# EAGLE schematic Resistor_Resistor (EAGLE 8.3.0), part 20 of 43
## Parts (continued)
R27278  10K  RESISTOR_0201  [0201]
R27279  10K  RESISTOR_0201  [0201]
R27280  10K  RESISTOR_0201  [0201]
R27281  10K  RESISTOR_0201  [0201]
R27282  10K  RESISTOR_0201  [0201]
R27283  10K  RESISTOR_0201  [0201]
R27284  10K  RESISTOR_0201  [0201]
R27285  10K  RESISTOR_0201  [0201]
R27286  10K  RESISTOR_0201  [0201]
R27287  10K  RESISTOR_0201  [0201]
R27288  10K  RESISTOR_0201  [0201]
R27289  10K  RESISTOR_0201  [0201]
R27290  10K  RESISTOR_0201  [0201]
R27291  10K  RESISTOR_0201  [0201]
R27292  10K  RESISTOR_0201  [0201]
R27293  10K  RESISTOR_0201  [0201]
R27294  10K  RESISTOR_0201  [0201]
R27295  10K  RESISTOR_0201  [0201]
R27296  10K  RESISTOR_0201  [0201]
R27297  10K  RESISTOR_0201  [0201]
R27298  10K  RESISTOR_0201  [0201]
R27299  10K  RESISTOR_0201  [0201]
R27300  10K  RESISTOR_0201  [0201]
R27301  10K  RESISTOR_0201  [0201]
R27302  10K  RESISTOR_0201  [0201]
R27303  10K  RESISTOR_0201  [0201]
R27304  10K  RESISTOR_0201  [0201]
R27305  10K  RESISTOR_0201  [0201]
R27306  10K  RESISTOR_0201  [0201]
R27307  10K  RESISTOR_0201  [0201]
R27308  10K  RESISTOR_0201  [0201]
R27309  10K  RESISTOR_0201  [0201]
R27310  10K  RESISTOR_0201  [0201]
R27311  10K  RESISTOR_0201  [0201]
R27312  10K  RESISTOR_0201  [0201]
R27313  10K  RESISTOR_0201  [0201]
R27314  10K  RESISTOR_0201  [0201]
R27315  10K  RESISTOR_0201  [0201]
R27316  10K  RESISTOR_0201  [0201]
R27317  10K  RESISTOR_0201  [0201]
R27318  10K  RESISTOR_0201  [0201]
R27319  10K  RESISTOR_0201  [0201]
R27320  10K  RESISTOR_0201  [0201]
R27321  10K  RESISTOR_0201  [0201]
R27322  10K  RESISTOR_0201  [0201]
R27323  10K  RESISTOR_0201  [0201]
R27324  10K  RESISTOR_0201  [0201]
R27325  10K  RESISTOR_0201  [0201]
R27326  10K  RESISTOR_0201  [0201]
R27327  10K  RESISTOR_0201  [0201]
R27328  10K  RESISTOR_0201  [0201]
R27329  10K  RESISTOR_0201  [0201]
R27330  10K  RESISTOR_0201  [0201]
R27331  10K  RESISTOR_0201  [0201]
R27332  10K  RESISTOR_0201  [0201]
R27333  10K  RESISTOR_0201  [0201]
R27334  10K  RESISTOR_0201  [0201]
R27335  10K  RESISTOR_0201  [0201]
R27336  10K  RESISTOR_0201  [0201]
R27337  10K  RESISTOR_0201  [0201]
R27338  10K  RESISTOR_0201  [0201]
R27339  10K  RESISTOR_0201  [0201]
R27340  10K  RESISTOR_0201  [0201]
R27341  10K  RESISTOR_0201  [0201]
R27342  10K  RESISTOR_0201  [0201]
R27343  10K  RESISTOR_0201  [0201]
R27344  10K  RESISTOR_0201  [0201]
R27345  10K  RESISTOR_0201  [0201]
R27346  10K  RESISTOR_0201  [0201]
R27347  10K  RESISTOR_0201  [0201]
R27348  10K  RESISTOR_0201  [0201]
R27349  10K  RESISTOR_0201  [0201]
R27350  10K  RESISTOR_0201  [0201]
R27351  10K  RESISTOR_0201  [0201]
R27352  10K  RESISTOR_0201  [0201]
R27353  10K  RESISTOR_0201  [0201]
R27354  10K  RESISTOR_0201  [0201]
R27355  10K  RESISTOR_0201  [0201]
R27356  10K  RESISTOR_0201  [0201]
R27357  10K  RESISTOR_0201  [0201]
R27358  10K  RESISTOR_0201  [0201]
R27359  10K  RESISTOR_0201  [0201]
R27360  10K  RESISTOR_0201  [0201]
R27361  10K  RESISTOR_0201  [0201]
R27362  10K  RESISTOR_0201  [0201]
R27363  10K  RESISTOR_0201  [0201]
R27364  10K  RESISTOR_0201  [0201]
R27365  10K  RESISTOR_0201  [0201]
R27366  10K  RESISTOR_0201  [0201]
R27367  10K  RESISTOR_0201  [0201]
R27368  10K  RESISTOR_0201  [0201]
R27369  10K  RESISTOR_0201  [0201]
R27370  10K  RESISTOR_0201  [0201]
R27371  10K  RESISTOR_0201  [0201]
R27372  10K  RESISTOR_0201  [0201]
R27373  10K  RESISTOR_0201  [0201]
R27374  10K  RESISTOR_0201  [0201]
R27375  10K  RESISTOR_0201  [0201]
R27376  10K  RESISTOR_0201  [0201]
R27377  10K  RESISTOR_0201  [0201]
R27378  10K  RESISTOR_0201  [0201]
R27379  10K  RESISTOR_0201  [0201]
R27380  10K  RESISTOR_0201  [0201]
R27381  10K  RESISTOR_0201  [0201]
R27382  10K  RESISTOR_0201  [0201]
R27383  10K  RESISTOR_0201  [0201]
R27384  10K  RESISTOR_0201  [0201]
R27385  10K  RESISTOR_0201  [0201]
R27386  10K  RESISTOR_0201  [0201]
R27387  10K  RESISTOR_0201  [0201]
R27388  10K  RESISTOR_0201  [0201]
R27389  10K  RESISTOR_0201  [0201]
R27390  10K  RESISTOR_0201  [0201]
R27391  10K  RESISTOR_0201  [0201]
R27392  10K  RESISTOR_0201  [0201]
R27393  10K  RESISTOR_0201  [0201]
R27394  10K  RESISTOR_0201  [0201]
R27395  10K  RESISTOR_0201  [0201]
R27396  10K  RESISTOR_0201  [0201]
R27397  10K  RESISTOR_0201  [0201]
R27398  10K  RESISTOR_0201  [0201]
R27399  10K  RESISTOR_0201  [0201]
R27400  10K  RESISTOR_0201  [0201]
R27401  10K  RESISTOR_0201  [0201]
R27402  10K  RESISTOR_0201  [0201]
R27403  10K  RESISTOR_0201  [0201]
R27404  10K  RESISTOR_0201  [0201]
R27405  10K  RESISTOR_0201  [0201]
R27406  10K  RESISTOR_0201  [0201]
R27407  10K  RESISTOR_0201  [0201]
R27408  10K  RESISTOR_0201  [0201]
R27409  10K  RESISTOR_0201  [0201]
R27410  10K  RESISTOR_0201  [0201]
R27411  10K  RESISTOR_0201  [0201]
R27412  10K  RESISTOR_0201  [0201]
R27413  10K  RESISTOR_0201  [0201]
R27414  10K  RESISTOR_0201  [0201]
R27415  10K  RESISTOR_0201  [0201]
R27416  10K  RESISTOR_0201  [0201]
R27417  10K  RESISTOR_0201  [0201]
R27418  10K  RESISTOR_0201  [0201]
R27419  10K  RESISTOR_0201  [0201]
R27420  10K  RESISTOR_0201  [0201]
R27421  10K  RESISTOR_0201  [0201]
R27422  10K  RESISTOR_0201  [0201]
R27423  10K  RESISTOR_0201  [0201]
R27424  10K  RESISTOR_0201  [0201]
R27425  10K  RESISTOR_0201  [0201]
R27426  10K  RESISTOR_0201  [0201]
R27427  10K  RESISTOR_0201  [0201]
R27428  10K  RESISTOR_0201  [0201]
R27429  10K  RESISTOR_0201  [0201]
R27430  10K  RESISTOR_0201  [0201]
R27431  10K  RESISTOR_0201  [0201]
R27432  10K  RESISTOR_0201  [0201]
R27433  10K  RESISTOR_0201  [0201]
R27434  10K  RESISTOR_0201  [0201]
R27435  10K  RESISTOR_0201  [0201]
R27436  10K  RESISTOR_0201  [0201]
R27437  10K  RESISTOR_0201  [0201]
R27438  10K  RESISTOR_0201  [0201]
R27439  10K  RESISTOR_0201  [0201]
R27440  10K  RESISTOR_0201  [0201]
R27441  10K  RESISTOR_0201  [0201]
R27442  10K  RESISTOR_0201  [0201]
R27443  10K  RESISTOR_0201  [0201]
R27444  10K  RESISTOR_0201  [0201]
R27445  10K  RESISTOR_0201  [0201]
R27446  10K  RESISTOR_0201  [0201]
R27447  10K  RESISTOR_0201  [0201]
R27448  10K  RESISTOR_0201  [0201]
R27449  10K  RESISTOR_0201  [0201]
R27450  10K  RESISTOR_0201  [0201]
R27451  10K  RESISTOR_0201  [0201]
R27452  10K  RESISTOR_0201  [0201]
R27453  10K  RESISTOR_0201  [0201]
R27454  10K  RESISTOR_0201  [0201]
R27455  10K  RESISTOR_0201  [0201]
R27456  10K  RESISTOR_0201  [0201]
R27457  10K  RESISTOR_0201  [0201]
R27458  10K  RESISTOR_0201  [0201]
R27459  10K  RESISTOR_0201  [0201]
R27460  10K  RESISTOR_0201  [0201]
R27461  10K  RESISTOR_0201  [0201]
R27462  10K  RESISTOR_0201  [0201]
R27463  10K  RESISTOR_0201  [0201]
R27464  10K  RESISTOR_0201  [0201]
R27465  10K  RESISTOR_0201  [0201]
R27466  10K  RESISTOR_0201  [0201]
R27467  10K  RESISTOR_0201  [0201]
R27468  10K  RESISTOR_0201  [0201]
R27469  10K  RESISTOR_0201  [0201]
R27470  10K  RESISTOR_0201  [0201]
R27471  10K  RESISTOR_0201  [0201]
R27472  10K  RESISTOR_0201  [0201]
R27473  10K  RESISTOR_0201  [0201]
R27474  10K  RESISTOR_0201  [0201]
R27475  10K  RESISTOR_0201  [0201]
R27476  10K  RESISTOR_0201  [0201]
R27477  10K  RESISTOR_0201  [0201]
R27478  10K  RESISTOR_0201  [0201]
R27479  10K  RESISTOR_0201  [0201]
R27480  10K  RESISTOR_0201  [0201]
R27481  10K  RESISTOR_0201  [0201]
R27482  10K  RESISTOR_0201  [0201]
R27483  10K  RESISTOR_0201  [0201]
R27484  10K  RESISTOR_0201  [0201]
R27485  10K  RESISTOR_0201  [0201]
R27486  10K  RESISTOR_0201  [0201]
R27487  10K  RESISTOR_0201  [0201]
R27488  10K  RESISTOR_0201  [0201]
R27489  10K  RESISTOR_0201  [0201]
R27490  10K  RESISTOR_0201  [0201]
R27491  10K  RESISTOR_0201  [0201]
R27492  10K  RESISTOR_0201  [0201]
R27493  10K  RESISTOR_0201  [0201]
R27494  10K  RESISTOR_0201  [0201]
R27495  10K  RESISTOR_0201  [0201]
R27496  10K  RESISTOR_0201  [0201]
R27497  10K  RESISTOR_0201  [0201]
R27498  10K  RESISTOR_0201  [0201]
R27499  10K  RESISTOR_0201  [0201]
R27500  10K  RESISTOR_0201  [0201]
R27501  10K  RESISTOR_0201  [0201]
R27502  10K  RESISTOR_0201  [0201]
R27503  10K  RESISTOR_0201  [0201]
R27504  10K  RESISTOR_0201  [0201]
R27505  10K  RESISTOR_0201  [0201]
R27506  10K  RESISTOR_0201  [0201]
R27507  10K  RESISTOR_0201  [0201]
R27508  10K  RESISTOR_0201  [0201]
R27509  10K  RESISTOR_0201  [0201]
R27510  10K  RESISTOR_0201  [0201]
R27511  10K  RESISTOR_0201  [0201]
R27512  10K  RESISTOR_0201  [0201]
R27513  10K  RESISTOR_0201  [0201]
R27514  10K  RESISTOR_0201  [0201]
R27515  10K  RESISTOR_0201  [0201]
R27516  10K  RESISTOR_0201  [0201]
R27517  10K  RESISTOR_0201  [0201]
R27518  10K  RESISTOR_0201  [0201]
R27519  10K  RESISTOR_0201  [0201]
R27520  10K  RESISTOR_0201  [0201]
R27521  10K  RESISTOR_0201  [0201]
R27522  10K  RESISTOR_0201  [0201]
R27523  10K  RESISTOR_0201  [0201]
R27524  10K  RESISTOR_0201  [0201]
R27525  10K  RESISTOR_0201  [0201]
R27526  10K  RESISTOR_0201  [0201]
R27527  10K  RESISTOR_0201  [0201]
R27528  10K  RESISTOR_0201  [0201]
R27529  10K  RESISTOR_0201  [0201]
R27530  10K  RESISTOR_0201  [0201]
R27531  10K  RESISTOR_0201  [0201]
R27532  10K  RESISTOR_0201  [0201]
R27533  10K  RESISTOR_0201  [0201]
R27534  10K  RESISTOR_0201  [0201]
R27535  10K  RESISTOR_0201  [0201]
R27536  10K  RESISTOR_0201  [0201]
R27537  10K  RESISTOR_0201  [0201]
R27538  10K  RESISTOR_0201  [0201]
R27539  10K  RESISTOR_0201  [0201]
R27540  10K  RESISTOR_0201  [0201]
R27541  10K  RESISTOR_0201  [0201]
R27542  10K  RESISTOR_0201  [0201]
R27543  10K  RESISTOR_0201  [0201]
R27544  10K  RESISTOR_0201  [0201]
R27545  10K  RESISTOR_0201  [0201]
R27546  10K  RESISTOR_0201  [0201]
R27547  10K  RESISTOR_0201  [0201]
R27548  10K  RESISTOR_0201  [0201]
R27549  10K  RESISTOR_0201  [0201]
R27550  10K  RESISTOR_0201  [0201]
R27551  10K  RESISTOR_0201  [0201]
R27552  10K  RESISTOR_0201  [0201]
R27553  10K  RESISTOR_0201  [0201]
R27554  10K  RESISTOR_0201  [0201]
R27555  10K  RESISTOR_0201  [0201]
R27556  10K  RESISTOR_0201  [0201]
R27557  10K  RESISTOR_0201  [0201]
R27558  10K  RESISTOR_0201  [0201]
R27559  10K  RESISTOR_0201  [0201]
R27560  10K  RESISTOR_0201  [0201]
R27561  10K  RESISTOR_0201  [0201]
R27562  10K  RESISTOR_0201  [0201]
R27563  10K  RESISTOR_0201  [0201]
R27564  10K  RESISTOR_0201  [0201]
R27565  10K  RESISTOR_0201  [0201]
R27566  10K  RESISTOR_0201  [0201]
R27567  10K  RESISTOR_0201  [0201]
R27568  10K  RESISTOR_0201  [0201]
R27569  10K  RESISTOR_0201  [0201]
R27570  10K  RESISTOR_0201  [0201]
R27571  10K  RESISTOR_0201  [0201]
R27572  10K  RESISTOR_0201  [0201]
R27573  10K  RESISTOR_0201  [0201]
R27574  10K  RESISTOR_0201  [0201]
R27575  10K  RESISTOR_0201  [0201]
R27576  10K  RESISTOR_0201  [0201]
R27577  10K  RESISTOR_0201  [0201]
R27578  10K  RESISTOR_0201  [0201]
R27579  10K  RESISTOR_0201  [0201]
R27580  10K  RESISTOR_0201  [0201]
R27581  10K  RESISTOR_0201  [0201]
R27582  10K  RESISTOR_0201  [0201]
R27583  10K  RESISTOR_0201  [0201]
R27584  10K  RESISTOR_0201  [0201]
R27585  10K  RESISTOR_0201  [0201]
R27586  10K  RESISTOR_0201  [0201]
R27587  10K  RESISTOR_0201  [0201]
R27588  10K  RESISTOR_0201  [0201]
R27589  10K  RESISTOR_0201  [0201]
R27590  10K  RESISTOR_0201  [0201]
R27591  10K  RESISTOR_0201  [0201]
R27592  10K  RESISTOR_0201  [0201]
R27593  10K  RESISTOR_0201  [0201]
R27594  10K  RESISTOR_0201  [0201]
R27595  10K  RESISTOR_0201  [0201]
R27596  10K  RESISTOR_0201  [0201]
R27597  10K  RESISTOR_0201  [0201]
R27598  10K  RESISTOR_0201  [0201]
R27599  10K  RESISTOR_0201  [0201]
R27600  10K  RESISTOR_0201  [0201]
R27601  10K  RESISTOR_0201  [0201]
R27602  10K  RESISTOR_0201  [0201]
R27603  10K  RESISTOR_0201  [0201]
R27604  10K  RESISTOR_0201  [0201]
R27605  10K  RESISTOR_0201  [0201]
R27606  10K  RESISTOR_0201  [0201]
R27607  10K  RESISTOR_0201  [0201]
R27608  10K  RESISTOR_0201  [0201]
R27609  10K  RESISTOR_0201  [0201]
R27610  10K  RESISTOR_0201  [0201]
R27611  10K  RESISTOR_0201  [0201]
R27612  10K  RESISTOR_0201  [0201]
R27613  10K  RESISTOR_0201  [0201]
R27614  10K  RESISTOR_0201  [0201]
R27615  10K  RESISTOR_0201  [0201]
R27616  10K  RESISTOR_0201  [0201]
R27617  10K  RESISTOR_0201  [0201]
R27618  10K  RESISTOR_0201  [0201]
R27619  10K  RESISTOR_0201  [0201]
R27620  10K  RESISTOR_0201  [0201]
R27621  10K  RESISTOR_0201  [0201]
R27622  10K  RESISTOR_0201  [0201]
R27623  10K  RESISTOR_0201  [0201]
R27624  10K  RESISTOR_0201  [0201]
R27625  10K  RESISTOR_0201  [0201]
R27626  10K  RESISTOR_0201  [0201]
R27627  10K  RESISTOR_0201  [0201]
R27628  10K  RESISTOR_0201  [0201]
R27629  10K  RESISTOR_0201  [0201]
R27630  10K  RESISTOR_0201  [0201]
R27631  10K  RESISTOR_0201  [0201]
R27632  10K  RESISTOR_0201  [0201]
R27633  10K  RESISTOR_0201  [0201]
R27634  10K  RESISTOR_0201  [0201]
R27635  10K  RESISTOR_0201  [0201]
R27636  10K  RESISTOR_0201  [0201]
R27637  10K  RESISTOR_0201  [0201]
R27638  10K  RESISTOR_0201  [0201]
R27639  10K  RESISTOR_0201  [0201]
R27640  10K  RESISTOR_0201  [0201]
R27641  10K  RESISTOR_0201  [0201]
R27642  10K  RESISTOR_0201  [0201]
R27643  10K  RESISTOR_0201  [0201]
R27644  10K  RESISTOR_0201  [0201]
R27645  10K  RESISTOR_0201  [0201]
R27646  10K  RESISTOR_0201  [0201]
R27647  10K  RESISTOR_0201  [0201]
R27648  10K  RESISTOR_0201  [0201]
R27649  10K  RESISTOR_0201  [0201]
R27650  10K  RESISTOR_0201  [0201]
R27651  10K  RESISTOR_0201  [0201]
R27652  10K  RESISTOR_0201  [0201]
R27653  10K  RESISTOR_0201  [0201]
R27654  10K  RESISTOR_0201  [0201]
R27655  10K  RESISTOR_0201  [0201]
R27656  10K  RESISTOR_0201  [0201]
R27657  10K  RESISTOR_0201  [0201]
R27658  10K  RESISTOR_0201  [0201]
R27659  10K  RESISTOR_0201  [0201]
R27660  10K  RESISTOR_0201  [0201]
R27661  10K  RESISTOR_0201  [0201]
R27662  10K  RESISTOR_0201  [0201]
R27663  10K  RESISTOR_0201  [0201]
R27664  10K  RESISTOR_0201  [0201]
R27665  10K  RESISTOR_0201  [0201]
R27666  10K  RESISTOR_0201  [0201]
R27667  10K  RESISTOR_0201  [0201]
R27668  10K  RESISTOR_0201  [0201]
R27669  10K  RESISTOR_0201  [0201]
R27670  10K  RESISTOR_0201  [0201]
R27671  10K  RESISTOR_0201  [0201]
R27672  10K  RESISTOR_0201  [0201]
R27673  10K  RESISTOR_0201  [0201]
R27674  10K  RESISTOR_0201  [0201]
R27675  10K  RESISTOR_0201  [0201]
R27676  10K  RESISTOR_0201  [0201]
R27677  10K  RESISTOR_0201  [0201]
R27678  10K  RESISTOR_0201  [0201]
R27679  10K  RESISTOR_0201  [0201]
R27680  10K  RESISTOR_0201  [0201]
R27681  10K  RESISTOR_0201  [0201]
R27682  10K  RESISTOR_0201  [0201]
R27683  10K  RESISTOR_0201  [0201]
R27684  10K  RESISTOR_0201  [0201]
R27685  10K  RESISTOR_0201  [0201]
R27686  10K  RESISTOR_0201  [0201]
R27687  10K  RESISTOR_0201  [0201]
R27688  10K  RESISTOR_0201  [0201]
R27689  10K  RESISTOR_0201  [0201]
R27690  10K  RESISTOR_0201  [0201]
R27691  10K  RESISTOR_0201  [0201]
R27692  10K  RESISTOR_0201  [0201]
R27693  10K  RESISTOR_0201  [0201]
R27694  10K  RESISTOR_0201  [0201]
R27695  10K  RESISTOR_0201  [0201]
R27696  10K  RESISTOR_0201  [0201]
R27697  10K  RESISTOR_0201  [0201]
R27698  10K  RESISTOR_0201  [0201]
R27699  10K  RESISTOR_0201  [0201]
R27700  10K  RESISTOR_0201  [0201]
R27701  10K  RESISTOR_0201  [0201]
R27702  10K  RESISTOR_0201  [0201]
R27703  10K  RESISTOR_0201  [0201]
R27704  10K  RESISTOR_0201  [0201]
R27705  10K  RESISTOR_0201  [0201]
R27706  10K  RESISTOR_0201  [0201]
R27707  10K  RESISTOR_0201  [0201]
R27708  10K  RESISTOR_0201  [0201]
R27709  10K  RESISTOR_0201  [0201]
R27710  10K  RESISTOR_0201  [0201]
R27711  10K  RESISTOR_0201  [0201]
R27712  10K  RESISTOR_0201  [0201]
R27713  10K  RESISTOR_0201  [0201]
R27714  10K  RESISTOR_0201  [0201]
R27715  10K  RESISTOR_0201  [0201]
R27716  10K  RESISTOR_0201  [0201]
R27717  10K  RESISTOR_0201  [0201]
R27718  10K  RESISTOR_0201  [0201]
R27719  10K  RESISTOR_0201  [0201]
R27720  10K  RESISTOR_0201  [0201]
R27721  10K  RESISTOR_0201  [0201]
R27722  10K  RESISTOR_0201  [0201]
R27723  10K  RESISTOR_0201  [0201]
R27724  10K  RESISTOR_0201  [0201]
R27725  10K  RESISTOR_0201  [0201]
R27726  10K  RESISTOR_0201  [0201]
R27727  10K  RESISTOR_0201  [0201]
R27728  10K  RESISTOR_0201  [0201]
R27729  10K  RESISTOR_0201  [0201]
R27730  10K  RESISTOR_0201  [0201]
R27731  10K  RESISTOR_0201  [0201]
R27732  10K  RESISTOR_0201  [0201]
R27733  10K  RESISTOR_0201  [0201]
R27734  10K  RESISTOR_0201  [0201]
R27735  10K  RESISTOR_0201  [0201]
R27736  10K  RESISTOR_0201  [0201]
R27737  10K  RESISTOR_0201  [0201]
R27738  10K  RESISTOR_0201  [0201]
R27739  10K  RESISTOR_0201  [0201]
R27740  10K  RESISTOR_0201  [0201]
R27741  10K  RESISTOR_0201  [0201]
R27742  10K  RESISTOR_0201  [0201]
R27743  10K  RESISTOR_0201  [0201]
R27744  10K  RESISTOR_0201  [0201]
R27745  10K  RESISTOR_0201  [0201]
R27746  10K  RESISTOR_0201  [0201]
R27747  10K  RESISTOR_0201  [0201]
R27748  10K  RESISTOR_0201  [0201]
R27749  10K  RESISTOR_0201  [0201]
R27750  10K  RESISTOR_0201  [0201]
R27751  10K  RESISTOR_0201  [0201]
R27752  10K  RESISTOR_0201  [0201]
R27753  10K  RESISTOR_0201  [0201]
R27754  10K  RESISTOR_0201  [0201]
R27755  10K  RESISTOR_0201  [0201]
R27756  10K  RESISTOR_0201  [0201]
R27757  10K  RESISTOR_0201  [0201]
R27758  10K  RESISTOR_0201  [0201]
R27759  10K  RESISTOR_0201  [0201]
R27760  10K  RESISTOR_0201  [0201]
R27761  10K  RESISTOR_0201  [0201]
R27762  10K  RESISTOR_0201  [0201]
R27763  10K  RESISTOR_0201  [0201]
R27764  10K  RESISTOR_0201  [0201]
R27765  10K  RESISTOR_0201  [0201]
R27766  10K  RESISTOR_0201  [0201]
R27767  10K  RESISTOR_0201  [0201]
R27768  10K  RESISTOR_0201  [0201]
R27769  10K  RESISTOR_0201  [0201]
R27770  10K  RESISTOR_0201  [0201]
R27771  10K  RESISTOR_0201  [0201]
R27772  10K  RESISTOR_0201  [0201]
R27773  10K  RESISTOR_0201  [0201]
R27774  10K  RESISTOR_0201  [0201]
R27775  10K  RESISTOR_0201  [0201]
R27776  10K  RESISTOR_0201  [0201]
R27777  10K  RESISTOR_0201  [0201]
R27778  10K  RESISTOR_0201  [0201]
R27779  10K  RESISTOR_0201  [0201]
R27780  10K  RESISTOR_0201  [0201]
R27781  10K  RESISTOR_0201  [0201]
R27782  10K  RESISTOR_0201  [0201]
R27783  10K  RESISTOR_0201  [0201]
R27784  10K  RESISTOR_0201  [0201]
R27785  10K  RESISTOR_0201  [0201]
R27786  10K  RESISTOR_0201  [0201]
R27787  10K  RESISTOR_0201  [0201]
R27788  10K  RESISTOR_0201  [0201]
R27789  10K  RESISTOR_0201  [0201]
R27790  10K  RESISTOR_0201  [0201]
R27791  10K  RESISTOR_0201  [0201]
R27792  10K  RESISTOR_0201  [0201]
R27793  10K  RESISTOR_0201  [0201]
R27794  10K  RESISTOR_0201  [0201]
R27795  10K  RESISTOR_0201  [0201]
R27796  10K  RESISTOR_0201  [0201]
R27797  10K  RESISTOR_0201  [0201]
R27798  10K  RESISTOR_0201  [0201]
R27799  10K  RESISTOR_0201  [0201]
R27800  10K  RESISTOR_0201  [0201]
R27801  10K  RESISTOR_0201  [0201]
R27802  10K  RESISTOR_0201  [0201]
R27803  10K  RESISTOR_0201  [0201]
R27804  10K  RESISTOR_0201  [0201]
R27805  10K  RESISTOR_0201  [0201]
R27806  10K  RESISTOR_0201  [0201]
R27807  10K  RESISTOR_0201  [0201]
R27808  10K  RESISTOR_0201  [0201]
R27809  10K  RESISTOR_0201  [0201]
R27810  10K  RESISTOR_0201  [0201]
R27811  10K  RESISTOR_0201  [0201]
R27812  10K  RESISTOR_0201  [0201]
R27813  10K  RESISTOR_0201  [0201]
R27814  10K  RESISTOR_0201  [0201]
R27815  10K  RESISTOR_0201  [0201]
R27816  10K  RESISTOR_0201  [0201]
R27817  10K  RESISTOR_0201  [0201]
R27818  10K  RESISTOR_0201  [0201]
R27819  10K  RESISTOR_0201  [0201]
R27820  10K  RESISTOR_0201  [0201]
R27821  10K  RESISTOR_0201  [0201]
R27822  10K  RESISTOR_0201  [0201]
R27823  10K  RESISTOR_0201  [0201]
R27824  10K  RESISTOR_0201  [0201]
R27825  10K  RESISTOR_0201  [0201]
R27826  10K  RESISTOR_0201  [0201]
R27827  10K  RESISTOR_0201  [0201]
R27828  10K  RESISTOR_0201  [0201]
R27829  10K  RESISTOR_0201  [0201]
R27830  10K  RESISTOR_0201  [0201]
R27831  10K  RESISTOR_0201  [0201]
R27832  10K  RESISTOR_0201  [0201]
R27833  10K  RESISTOR_0201  [0201]
R27834  10K  RESISTOR_0201  [0201]
R27835  10K  RESISTOR_0201  [0201]
R27836  10K  RESISTOR_0201  [0201]
R27837  10K  RESISTOR_0201  [0201]
R27838  10K  RESISTOR_0201  [0201]
R27839  10K  RESISTOR_0201  [0201]
R27840  10K  RESISTOR_0201  [0201]
R27841  10K  RESISTOR_0201  [0201]
R27842  10K  RESISTOR_0201  [0201]
R27843  10K  RESISTOR_0201  [0201]
R27844  10K  RESISTOR_0201  [0201]
R27845  10K  RESISTOR_0201  [0201]
R27846  10K  RESISTOR_0201  [0201]
R27847  10K  RESISTOR_0201  [0201]
R27848  10K  RESISTOR_0201  [0201]
R27849  10K  RESISTOR_0201  [0201]
R27850  10K  RESISTOR_0201  [0201]
R27851  10K  RESISTOR_0201  [0201]
R27852  10K  RESISTOR_0201  [0201]
R27853  10K  RESISTOR_0201  [0201]
R27854  10K  RESISTOR_0201  [0201]
R27855  10K  RESISTOR_0201  [0201]
R27856  10K  RESISTOR_0201  [0201]
R27857  10K  RESISTOR_0201  [0201]
R27858  10K  RESISTOR_0201  [0201]
R27859  10K  RESISTOR_0201  [0201]
R27860  10K  RESISTOR_0201  [0201]
R27861  10K  RESISTOR_0201  [0201]
R27862  10K  RESISTOR_0201  [0201]
R27863  10K  RESISTOR_0201  [0201]
R27864  10K  RESISTOR_0201  [0201]
R27865  10K  RESISTOR_0201  [0201]
R27866  10K  RESISTOR_0201  [0201]
R27867  10K  RESISTOR_0201  [0201]
R27868  10K  RESISTOR_0201  [0201]
R27869  10K  RESISTOR_0201  [0201]
R27870  10K  RESISTOR_0201  [0201]
R27871  10K  RESISTOR_0201  [0201]
R27872  10K  RESISTOR_0201  [0201]
R27873  10K  RESISTOR_0201  [0201]
R27874  10K  RESISTOR_0201  [0201]
R27875  10K  RESISTOR_0201  [0201]
R27876  10K  RESISTOR_0201  [0201]
R27877  10K  RESISTOR_0201  [0201]
R27878  10K  RESISTOR_0201  [0201]
R27879  10K  RESISTOR_0201  [0201]
R27880  10K  RESISTOR_0201  [0201]
R27881  10K  RESISTOR_0201  [0201]
R27882  10K  RESISTOR_0201  [0201]
R27883  10K  RESISTOR_0201  [0201]
R27884  10K  RESISTOR_0201  [0201]
R27885  10K  RESISTOR_0201  [0201]
R27886  10K  RESISTOR_0201  [0201]
R27887  10K  RESISTOR_0201  [0201]
R27888  10K  RESISTOR_0201  [0201]
R27889  10K  RESISTOR_0201  [0201]
R27890  10K  RESISTOR_0201  [0201]
R27891  10K  RESISTOR_0201  [0201]
R27892  10K  RESISTOR_0201  [0201]
R27893  10K  RESISTOR_0201  [0201]
R27894  10K  RESISTOR_0201  [0201]
R27895  10K  RESISTOR_0201  [0201]
R27896  10K  RESISTOR_0201  [0201]
R27897  10K  RESISTOR_0201  [0201]
R27898  10K  RESISTOR_0201  [0201]
R27899  10K  RESISTOR_0201  [0201]
R27900  10K  RESISTOR_0201  [0201]
R27901  10K  RESISTOR_0201  [0201]
R27902  10K  RESISTOR_0201  [0201]
R27903  10K  RESISTOR_0201  [0201]
R27904  10K  RESISTOR_0201  [0201]
R27905  10K  RESISTOR_0201  [0201]
R27906  10K  RESISTOR_0201  [0201]
R27907  10K  RESISTOR_0201  [0201]
R27908  10K  RESISTOR_0201  [0201]
R27909  10K  RESISTOR_0201  [0201]
R27910  10K  RESISTOR_0201  [0201]
R27911  10K  RESISTOR_0201  [0201]
R27912  10K  RESISTOR_0201  [0201]
R27913  10K  RESISTOR_0201  [0201]
R27914  10K  RESISTOR_0201  [0201]
R27915  10K  RESISTOR_0201  [0201]
R27916  10K  RESISTOR_0201  [0201]
R27917  10K  RESISTOR_0201  [0201]
R27918  10K  RESISTOR_0201  [0201]
R27919  10K  RESISTOR_0201  [0201]
R27920  10K  RESISTOR_0201  [0201]
R27921  10K  RESISTOR_0201  [0201]
R27922  10K  RESISTOR_0201  [0201]
R27923  10K  RESISTOR_0201  [0201]
R27924  10K  RESISTOR_0201  [0201]
R27925  10K  RESISTOR_0201  [0201]
R27926  10K  RESISTOR_0201  [0201]
R27927  10K  RESISTOR_0201  [0201]
R27928  10K  RESISTOR_0201  [0201]
R27929  10K  RESISTOR_0201  [0201]
R27930  10K  RESISTOR_0201  [0201]
R27931  10K  RESISTOR_0201  [0201]
R27932  10K  RESISTOR_0201  [0201]
R27933  10K  RESISTOR_0201  [0201]
R27934  10K  RESISTOR_0201  [0201]
R27935  10K  RESISTOR_0201  [0201]
R27936  10K  RESISTOR_0201  [0201]
R27937  10K  RESISTOR_0201  [0201]
R27938  10K  RESISTOR_0201  [0201]
R27939  10K  RESISTOR_0201  [0201]
R27940  10K  RESISTOR_0201  [0201]
R27941  10K  RESISTOR_0201  [0201]
R27942  10K  RESISTOR_0201  [0201]
R27943  10K  RESISTOR_0201  [0201]
R27944  10K  RESISTOR_0201  [0201]
R27945  10K  RESISTOR_0201  [0201]
R27946  10K  RESISTOR_0201  [0201]
R27947  10K  RESISTOR_0201  [0201]
R27948  10K  RESISTOR_0201  [0201]
R27949  10K  RESISTOR_0201  [0201]
R27950  10K  RESISTOR_0201  [0201]
R27951  10K  RESISTOR_0201  [0201]
R27952  10K  RESISTOR_0201  [0201]
R27953  10K  RESISTOR_0201  [0201]
R27954  10K  RESISTOR_0201  [0201]
R27955  10K  RESISTOR_0201  [0201]
R27956  10K  RESISTOR_0201  [0201]
R27957  10K  RESISTOR_0201  [0201]
R27958  10K  RESISTOR_0201  [0201]
R27959  10K  RESISTOR_0201  [0201]
R27960  10K  RESISTOR_0201  [0201]
R27961  10K  RESISTOR_0201  [0201]
R27962  10K  RESISTOR_0201  [0201]
R27963  10K  RESISTOR_0201  [0201]
R27964  10K  RESISTOR_0201  [0201]
R27965  10K  RESISTOR_0201  [0201]
R27966  10K  RESISTOR_0201  [0201]
R27967  10K  RESISTOR_0201  [0201]
R27968  10K  RESISTOR_0201  [0201]
R27969  10K  RESISTOR_0201  [0201]
R27970  10K  RESISTOR_0201  [0201]
R27971  10K  RESISTOR_0201  [0201]
R27972  10K  RESISTOR_0201  [0201]
R27973  10K  RESISTOR_0201  [0201]
R27974  10K  RESISTOR_0201  [0201]
R27975  10K  RESISTOR_0201  [0201]
R27976  10K  RESISTOR_0201  [0201]
R27977  10K  RESISTOR_0201  [0201]
R27978  10K  RESISTOR_0201  [0201]
R27979  10K  RESISTOR_0201  [0201]
R27980  10K  RESISTOR_0201  [0201]
R27981  10K  RESISTOR_0201  [0201]
R27982  10K  RESISTOR_0201  [0201]
R27983  10K  RESISTOR_0201  [0201]
R27984  10K  RESISTOR_0201  [0201]
R27985  10K  RESISTOR_0201  [0201]
R27986  10K  RESISTOR_0201  [0201]
R27987  10K  RESISTOR_0201  [0201]
R27988  10K  RESISTOR_0201  [0201]
R27989  10K  RESISTOR_0201  [0201]
R27990  10K  RESISTOR_0201  [0201]
R27991  10K  RESISTOR_0201  [0201]
R27992  10K  RESISTOR_0201  [0201]
R27993  10K  RESISTOR_0201  [0201]
R27994  10K  RESISTOR_0201  [0201]
R27995  10K  RESISTOR_0201  [0201]
R27996  10K  RESISTOR_0201  [0201]
R27997  10K  RESISTOR_0201  [0201]
R27998  10K  RESISTOR_0201  [0201]
R27999  10K  RESISTOR_0201  [0201]
R28000  10K  RESISTOR_0201  [0201]
R28001  10K  RESISTOR_0201  [0201]
R28002  10K  RESISTOR_0201  [0201]
R28003  10K  RESISTOR_0201  [0201]
R28004  10K  RESISTOR_0201  [0201]
R28005  10K  RESISTOR_0201  [0201]
R28006  10K  RESISTOR_0201  [0201]
R28007  10K  RESISTOR_0201  [0201]
R28008  10K  RESISTOR_0201  [0201]
R28009  10K  RESISTOR_0201  [0201]
R28010  10K  RESISTOR_0201  [0201]
R28011  10K  RESISTOR_0201  [0201]
R28012  10K  RESISTOR_0201  [0201]
R28013  10K  RESISTOR_0201  [0201]
R28014  10K  RESISTOR_0201  [0201]
R28015  10K  RESISTOR_0201  [0201]
R28016  10K  RESISTOR_0201  [0201]
R28017  10K  RESISTOR_0201  [0201]
R28018  10K  RESISTOR_0201  [0201]
R28019  10K  RESISTOR_0201  [0201]
R28020  10K  RESISTOR_0201  [0201]
R28021  10K  RESISTOR_0201  [0201]
R28022  10K  RESISTOR_0201  [0201]
R28023  10K  RESISTOR_0201  [0201]
R28024  10K  RESISTOR_0201  [0201]
R28025  10K  RESISTOR_0201  [0201]
R28026  10K  RESISTOR_0201  [0201]
R28027  10K  RESISTOR_0201  [0201]
R28028  10K  RESISTOR_0201  [0201]
R28029  10K  RESISTOR_0201  [0201]
R28030  10K  RESISTOR_0201  [0201]
R28031  10K  RESISTOR_0201  [0201]
R28032  10K  RESISTOR_0201  [0201]
R28033  10K  RESISTOR_0201  [0201]
R28034  10K  RESISTOR_0201  [0201]
R28035  10K  RESISTOR_0201  [0201]
R28036  10K  RESISTOR_0201  [0201]
R28037  10K  RESISTOR_0201  [0201]
R28038  10K  RESISTOR_0201  [0201]
R28039  10K  RESISTOR_0201  [0201]
R28040  10K  RESISTOR_0201  [0201]
R28041  10K  RESISTOR_0201  [0201]
R28042  10K  RESISTOR_0201  [0201]
R28043  10K  RESISTOR_0201  [0201]
R28044  10K  RESISTOR_0201  [0201]
R28045  10K  RESISTOR_0201  [0201]
R28046  10K  RESISTOR_0201  [0201]
R28047  10K  RESISTOR_0201  [0201]
R28048  10K  RESISTOR_0201  [0201]
R28049  10K  RESISTOR_0201  [0201]
R28050  10K  RESISTOR_0201  [0201]
R28051  10K  RESISTOR_0201  [0201]
R28052  10K  RESISTOR_0201  [0201]
R28053  10K  RESISTOR_0201  [0201]
R28054  10K  RESISTOR_0201  [0201]
R28055  10K  RESISTOR_0201  [0201]
R28056  10K  RESISTOR_0201  [0201]
R28057  10K  RESISTOR_0201  [0201]
R28058  10K  RESISTOR_0201  [0201]
R28059  10K  RESISTOR_0201  [0201]
R28060  10K  RESISTOR_0201  [0201]
R28061  10K  RESISTOR_0201  [0201]
R28062  10K  RESISTOR_0201  [0201]
R28063  10K  RESISTOR_0201  [0201]
R28064  10K  RESISTOR_0201  [0201]
R28065  10K  RESISTOR_0201  [0201]
R28066  10K  RESISTOR_0201  [0201]
R28067  10K  RESISTOR_0201  [0201]
R28068  10K  RESISTOR_0201  [0201]
R28069  10K  RESISTOR_0201  [0201]
R28070  10K  RESISTOR_0201  [0201]
R28071  10K  RESISTOR_0201  [0201]
R28072  10K  RESISTOR_0201  [0201]
R28073  10K  RESISTOR_0201  [0201]
R28074  10K  RESISTOR_0201  [0201]
R28075  10K  RESISTOR_0201  [0201]
R28076  10K  RESISTOR_0201  [0201]
R28077  10K  RESISTOR_0201  [0201]
R28078  10K  RESISTOR_0201  [0201]
R28079  10K  RESISTOR_0201  [0201]
R28080  10K  RESISTOR_0201  [0201]
R28081  10K  RESISTOR_0201  [0201]
R28082  10K  RESISTOR_0201  [0201]
R28083  10K  RESISTOR_0201  [0201]
R28084  10K  RESISTOR_0201  [0201]
R28085  10K  RESISTOR_0201  [0201]
R28086  10K  RESISTOR_0201  [0201]
R28087  10K  RESISTOR_0201  [0201]
R28088  10K  RESISTOR_0201  [0201]
R28089  10K  RESISTOR_0201  [0201]
R28090  10K  RESISTOR_0201  [0201]
R28091  10K  RESISTOR_0201  [0201]
R28092  10K  RESISTOR_0201  [0201]
R28093  10K  RESISTOR_0201  [0201]
R28094  10K  RESISTOR_0201  [0201]
R28095  10K  RESISTOR_0201  [0201]
R28096  10K  RESISTOR_0201  [0201]
R28097  10K  RESISTOR_0201  [0201]
R28098  10K  RESISTOR_0201  [0201]
R28099  10K  RESISTOR_0201  [0201]
R28100  10K  RESISTOR_0201  [0201]
R28101  10K  RESISTOR_0201  [0201]
R28102  10K  RESISTOR_0201  [0201]
R28103  10K  RESISTOR_0201  [0201]
R28104  10K  RESISTOR_0201  [0201]
R28105  10K  RESISTOR_0201  [0201]
R28106  10K  RESISTOR_0201  [0201]
R28107  10K  RESISTOR_0201  [0201]
R28108  10K  RESISTOR_0201  [0201]
R28109  10K  RESISTOR_0201  [0201]
R28110  10K  RESISTOR_0201  [0201]
R28111  10K  RESISTOR_0201  [0201]
R28112  10K  RESISTOR_0201  [0201]
R28113  10K  RESISTOR_0201  [0201]
R28114  10K  RESISTOR_0201  [0201]
R28115  10K  RESISTOR_0201  [0201]
R28116  10K  RESISTOR_0201  [0201]
R28117  10K  RESISTOR_0201  [0201]
R28118  10K  RESISTOR_0201  [0201]
R28119  10K  RESISTOR_0201  [0201]
R28120  10K  RESISTOR_0201  [0201]
R28121  10K  RESISTOR_0201  [0201]
R28122  10K  RESISTOR_0201  [0201]
R28123  10K  RESISTOR_0201  [0201]
R28124  10K  RESISTOR_0201  [0201]
R28125  10K  RESISTOR_0201  [0201]
R28126  10K  RESISTOR_0201  [0201]
R28127  10K  RESISTOR_0201  [0201]
R28128  10K  RESISTOR_0201  [0201]
R28129  10K  RESISTOR_0201  [0201]
R28130  10K  RESISTOR_0201  [0201]
R28131  10K  RESISTOR_0201  [0201]
R28132  10K  RESISTOR_0201  [0201]
R28133  10K  RESISTOR_0201  [0201]
R28134  10K  RESISTOR_0201  [0201]
R28135  10K  RESISTOR_0201  [0201]
R28136  10K  RESISTOR_0201  [0201]
R28137  10K  RESISTOR_0201  [0201]
R28138  10K  RESISTOR_0201  [0201]
R28139  10K  RESISTOR_0201  [0201]
R28140  10K  RESISTOR_0201  [0201]
R28141  10K  RESISTOR_0201  [0201]
R28142  10K  RESISTOR_0201  [0201]
R28143  10K  RESISTOR_0201  [0201]
R28144  10K  RESISTOR_0201  [0201]
R28145  10K  RESISTOR_0201  [0201]
R28146  10K  RESISTOR_0201  [0201]
R28147  10K  RESISTOR_0201  [0201]
R28148  10K  RESISTOR_0201  [0201]
R28149  10K  RESISTOR_0201  [0201]
R28150  10K  RESISTOR_0201  [0201]
R28151  10K  RESISTOR_0201  [0201]
R28152  10K  RESISTOR_0201  [0201]
R28153  10K  RESISTOR_0201  [0201]
R28154  10K  RESISTOR_0201  [0201]
R28155  10K  RESISTOR_0201  [0201]
R28156  10K  RESISTOR_0201  [0201]
R28157  10K  RESISTOR_0201  [0201]
R28158  10K  RESISTOR_0201  [0201]
R28159  10K  RESISTOR_0201  [0201]
R28160  10K  RESISTOR_0201  [0201]
R28161  10K  RESISTOR_0201  [0201]
R28162  10K  RESISTOR_0201  [0201]
R28163  10K  RESISTOR_0201  [0201]
R28164  10K  RESISTOR_0201  [0201]
R28165  10K  RESISTOR_0201  [0201]
R28166  10K  RESISTOR_0201  [0201]
R28167  10K  RESISTOR_0201  [0201]
R28168  10K  RESISTOR_0201  [0201]
R28169  10K  RESISTOR_0201  [0201]
R28170  10K  RESISTOR_0201  [0201]
R28171  10K  RESISTOR_0201  [0201]
R28172  10K  RESISTOR_0201  [0201]
R28173  10K  RESISTOR_0201  [0201]
R28174  10K  RESISTOR_0201  [0201]
R28175  10K  RESISTOR_0201  [0201]
R28176  10K  RESISTOR_0201  [0201]
R28177  10K  RESISTOR_0201  [0201]
R28178  10K  RESISTOR_0201  [0201]
R28179  10K  RESISTOR_0201  [0201]
R28180  10K  RESISTOR_0201  [0201]
R28181  10K  RESISTOR_0201  [0201]
R28182  10K  RESISTOR_0201  [0201]
R28183  10K  RESISTOR_0201  [0201]
R28184  10K  RESISTOR_0201  [0201]
R28185  10K  RESISTOR_0201  [0201]
R28186  10K  RESISTOR_0201  [0201]
R28187  10K  RESISTOR_0201  [0201]
R28188  10K  RESISTOR_0201  [0201]
R28189  10K  RESISTOR_0201  [0201]
R28190  10K  RESISTOR_0201  [0201]
R28191  10K  RESISTOR_0201  [0201]
R28192  10K  RESISTOR_0201  [0201]
R28193  10K  RESISTOR_0201  [0201]
R28194  10K  RESISTOR_0201  [0201]
R28195  10K  RESISTOR_0201  [0201]
R28196  10K  RESISTOR_0201  [0201]
R28197  10K  RESISTOR_0201  [0201]
R28198  10K  RESISTOR_0201  [0201]
R28199  10K  RESISTOR_0201  [0201]
R28200  10K  RESISTOR_0201  [0201]
R28201  10K  RESISTOR_0201  [0201]
R28202  10K  RESISTOR_0201  [0201]
R28203  10K  RESISTOR_0201  [0201]
R28204  10K  RESISTOR_0201  [0201]
R28205  10K  RESISTOR_0201  [0201]
R28206  10K  RESISTOR_0201  [0201]
R28207  10K  RESISTOR_0201  [0201]
R28208  10K  RESISTOR_0201  [0201]
R28209  10K  RESISTOR_0201  [0201]
R28210  10K  RESISTOR_0201  [0201]
R28211  10K  RESISTOR_0201  [0201]
R28212  10K  RESISTOR_0201  [0201]
R28213  10K  RESISTOR_0201  [0201]
R28214  10K  RESISTOR_0201  [0201]
R28215  10K  RESISTOR_0201  [0201]
R28216  10K  RESISTOR_0201  [0201]
R28217  10K  RESISTOR_0201  [0201]
R28218  10K  RESISTOR_0201  [0201]
R28219  10K  RESISTOR_0201  [0201]
R28220  10K  RESISTOR_0201  [0201]
R28221  10K  RESISTOR_0201  [0201]
R28222  10K  RESISTOR_0201  [0201]
R28223  10K  RESISTOR_0201  [0201]
R28224  10K  RESISTOR_0201  [0201]
R28225  10K  RESISTOR_0201  [0201]
R28226  10K  RESISTOR_0201  [0201]
R28227  10K  RESISTOR_0201  [0201]
R28228  10K  RESISTOR_0201  [0201]
R28229  10K  RESISTOR_0201  [0201]
R28230  10K  RESISTOR_0201  [0201]
R28231  10K  RESISTOR_0201  [0201]
R28232  10K  RESISTOR_0201  [0201]
R28233  10K  RESISTOR_0201  [0201]
R28234  10K  RESISTOR_0201  [0201]
R28235  10K  RESISTOR_0201  [0201]
R28236  10K  RESISTOR_0201  [0201]
R28237  10K  RESISTOR_0201  [0201]
R28238  10K  RESISTOR_0201  [0201]
R28239  10K  RESISTOR_0201  [0201]
R28240  10K  RESISTOR_0201  [0201]
R28241  10K  RESISTOR_0201  [0201]
R28242  10K  RESISTOR_0201  [0201]
R28243  10K  RESISTOR_0201  [0201]
R28244  10K  RESISTOR_0201  [0201]
R28245  10K  RESISTOR_0201  [0201]
R28246  10K  RESISTOR_0201  [0201]
R28247  10K  RESISTOR_0201  [0201]
R28248  10K  RESISTOR_0201  [0201]
R28249  10K  RESISTOR_0201  [0201]
R28250  10K  RESISTOR_0201  [0201]
R28251  10K  RESISTOR_0201  [0201]
R28252  10K  RESISTOR_0201  [0201]
R28253  10K  RESISTOR_0201  [0201]
R28254  10K  RESISTOR_0201  [0201]
R28255  10K  RESISTOR_0201  [0201]
R28256  10K  RESISTOR_0201  [0201]
R28257  10K  RESISTOR_0201  [0201]
R28258  10K  RESISTOR_0201  [0201]
R28259  10K  RESISTOR_0201  [0201]
R28260  10K  RESISTOR_0201  [0201]
R28261  10K  RESISTOR_0201  [0201]
R28262  10K  RESISTOR_0201  [0201]
R28263  10K  RESISTOR_0201  [0201]
R28264  10K  RESISTOR_0201  [0201]
R28265  10K  RESISTOR_0201  [0201]
R28266  10K  RESISTOR_0201  [0201]
R28267  10K  RESISTOR_0201  [0201]
R28268  10K  RESISTOR_0201  [0201]
R28269  10K  RESISTOR_0201  [0201]
R28270  10K  RESISTOR_0201  [0201]
R28271  10K  RESISTOR_0201  [0201]
R28272  10K  RESISTOR_0201  [0201]
R28273  10K  RESISTOR_0201  [0201]
R28274  10K  RESISTOR_0201  [0201]
R28275  10K  RESISTOR_0201  [0201]
R28276  10K  RESISTOR_0201  [0201]
R28277  10K  RESISTOR_0201  [0201]
R28278  10K  RESISTOR_0201  [0201]
R28279  10K  RESISTOR_0201  [0201]
R28280  10K  RESISTOR_0201  [0201]
R28281  10K  RESISTOR_0201  [0201]
R28282  10K  RESISTOR_0201  [0201]
R28283  10K  RESISTOR_0201  [0201]
R28284  10K  RESISTOR_0201  [0201]
R28285  10K  RESISTOR_0201  [0201]
R28286  10K  RESISTOR_0201  [0201]
R28287  10K  RESISTOR_0201  [0201]
R28288  10K  RESISTOR_0201  [0201]
R28289  10K  RESISTOR_0201  [0201]
R28290  10K  RESISTOR_0201  [0201]
R28291  10K  RESISTOR_0201  [0201]
R28292  10K  RESISTOR_0201  [0201]
R28293  10K  RESISTOR_0201  [0201]
R28294  10K  RESISTOR_0201  [0201]
R28295  10K  RESISTOR_0201  [0201]
R28296  10K  RESISTOR_0201  [0201]
R28297  10K  RESISTOR_0201  [0201]
R28298  10K  RESISTOR_0201  [0201]
R28299  10K  RESISTOR_0201  [0201]
R28300  10K  RESISTOR_0201  [0201]
R28301  10K  RESISTOR_0201  [0201]
R28302  10K  RESISTOR_0201  [0201]
R28303  10K  RESISTOR_0201  [0201]
R28304  10K  RESISTOR_0201  [0201]
R28305  10K  RESISTOR_0201  [0201]
R28306  10K  RESISTOR_0201  [0201]
R28307  10K  RESISTOR_0201  [0201]
R28308  10K  RESISTOR_0201  [0201]
R28309  10K  RESISTOR_0201  [0201]
R28310  10K  RESISTOR_0201  [0201]
R28311  10K  RESISTOR_0201  [0201]
R28312  10K  RESISTOR_0201  [0201]
R28313  10K  RESISTOR_0201  [0201]
R28314  10K  RESISTOR_0201  [0201]
R28315  10K  RESISTOR_0201  [0201]
R28316  10K  RESISTOR_0201  [0201]
R28317  10K  RESISTOR_0201  [0201]
R28318  10K  RESISTOR_0201  [0201]
R28319  10K  RESISTOR_0201  [0201]
R28320  10K  RESISTOR_0201  [0201]
R28321  10K  RESISTOR_0201  [0201]
R28322  10K  RESISTOR_0201  [0201]
R28323  10K  RESISTOR_0201  [0201]
R28324  10K  RESISTOR_0201  [0201]
R28325  10K  RESISTOR_0201  [0201]
R28326  10K  RESISTOR_0201  [0201]
R28327  10K  RESISTOR_0201  [0201]
R28328  10K  RESISTOR_0201  [0201]
R28329  10K  RESISTOR_0201  [0201]
R28330  10K  RESISTOR_0201  [0201]
R28331  10K  RESISTOR_0201  [0201]
R28332  10K  RESISTOR_0201  [0201]
R28333  10K  RESISTOR_0201  [0201]
R28334  10K  RESISTOR_0201  [0201]
R28335  10K  RESISTOR_0201  [0201]
R28336  10K  RESISTOR_0201  [0201]
R28337  10K  RESISTOR_0201  [0201]
R28338  10K  RESISTOR_0201  [0201]
R28339  10K  RESISTOR_0201  [0201]
R28340  10K  RESISTOR_0201  [0201]
R28341  10K  RESISTOR_0201  [0201]
R28342  10K  RESISTOR_0201  [0201]
R28343  10K  RESISTOR_0201  [0201]
R28344  10K  RESISTOR_0201  [0201]
R28345  10K  RESISTOR_0201  [0201]
R28346  10K  RESISTOR_0201  [0201]
R28347  10K  RESISTOR_0201  [0201]
R28348  10K  RESISTOR_0201  [0201]
R28349  10K  RESISTOR_0201  [0201]
R28350  10K  RESISTOR_0201  [0201]
R28351  10K  RESISTOR_0201  [0201]
R28352  10K  RESISTOR_0201  [0201]
R28353  10K  RESISTOR_0201  [0201]
R28354  10K  RESISTOR_0201  [0201]
R28355  10K  RESISTOR_0201  [0201]
R28356  10K  RESISTOR_0201  [0201]
R28357  10K  RESISTOR_0201  [0201]
R28358  10K  RESISTOR_0201  [0201]
R28359  10K  RESISTOR_0201  [0201]
R28360  10K  RESISTOR_0201  [0201]
R28361  10K  RESISTOR_0201  [0201]
R28362  10K  RESISTOR_0201  [0201]
R28363  10K  RESISTOR_0201  [0201]
R28364  10K  RESISTOR_0201  [0201]
R28365  10K  RESISTOR_0201  [0201]
R28366  10K  RESISTOR_0201  [0201]
R28367  10K  RESISTOR_0201  [0201]
R28368  10K  RESISTOR_0201  [0201]
R28369  10K  RESISTOR_0201  [0201]
R28370  10K  RESISTOR_0201  [0201]
R28371  10K  RESISTOR_0201  [0201]
R28372  10K  RESISTOR_0201  [0201]
R28373  10K  RESISTOR_0201  [0201]
R28374  10K  RESISTOR_0201  [0201]
R28375  10K  RESISTOR_0201  [0201]
R28376  10K  RESISTOR_0201  [0201]
R28377  10K  RESISTOR_0201  [0201]
R28378  10K  RESISTOR_0201  [0201]
R28379  10K  RESISTOR_0201  [0201]
R28380  10K  RESISTOR_0201  [0201]
R28381  10K  RESISTOR_0201  [0201]
R28382  10K  RESISTOR_0201  [0201]
R28383  10K  RESISTOR_0201  [0201]
R28384  10K  RESISTOR_0201  [0201]
R28385  10K  RESISTOR_0201  [0201]
R28386  10K  RESISTOR_0201  [0201]
R28387  10K  RESISTOR_0201  [0201]
R28388  10K  RESISTOR_0201  [0201]
R28389  10K  RESISTOR_0201  [0201]
R28390  10K  RESISTOR_0201  [0201]
R28391  10K  RESISTOR_0201  [0201]
R28392  10K  RESISTOR_0201  [0201]
R28393  10K  RESISTOR_0201  [0201]
R28394  10K  RESISTOR_0201  [0201]
R28395  10K  RESISTOR_0201  [0201]
R28396  10K  RESISTOR_0201  [0201]
R28397  10K  RESISTOR_0201  [0201]
R28398  10K  RESISTOR_0201  [0201]
R28399  10K  RESISTOR_0201  [0201]
R28400  10K  RESISTOR_0201  [0201]
R28401  10K  RESISTOR_0201  [0201]
R28402  10K  RESISTOR_0201  [0201]
R28403  10K  RESISTOR_0201  [0201]
R28404  10K  RESISTOR_0201  [0201]
R28405  10K  RESISTOR_0201  [0201]
R28406  10K  RESISTOR_0201  [0201]
R28407  10K  RESISTOR_0201  [0201]
R28408  10K  RESISTOR_0201  [0201]
R28409  10K  RESISTOR_0201  [0201]
R28410  10K  RESISTOR_0201  [0201]
R28411  10K  RESISTOR_0201  [0201]
R28412  10K  RESISTOR_0201  [0201]
R28413  10K  RESISTOR_0201  [0201]
R28414  10K  RESISTOR_0201  [0201]
R28415  10K  RESISTOR_0201  [0201]
R28416  10K  RESISTOR_0201  [0201]
R28417  10K  RESISTOR_0201  [0201]
R28418  10K  RESISTOR_0201  [0201]
R28419  10K  RESISTOR_0201  [0201]
R28420  10K  RESISTOR_0201  [0201]
R28421  10K  RESISTOR_0201  [0201]
R28422  10K  RESISTOR_0201  [0201]
R28423  10K  RESISTOR_0201  [0201]
R28424  10K  RESISTOR_0201  [0201]
R28425  10K  RESISTOR_0201  [0201]
R28426  10K  RESISTOR_0201  [0201]
R28427  10K  RESISTOR_0201  [0201]
R28428  10K  RESISTOR_0201  [0201]
R28429  10K  RESISTOR_0201  [0201]
R28430  10K  RESISTOR_0201  [0201]
R28431  10K  RESISTOR_0201  [0201]
R28432  10K  RESISTOR_0201  [0201]
R28433  10K  RESISTOR_0201  [0201]
R28434  10K  RESISTOR_0201  [0201]
R28435  10K  RESISTOR_0201  [0201]
R28436  10K  RESISTOR_0201  [0201]
R28437  10K  RESISTOR_0201  [0201]
R28438  10K  RESISTOR_0201  [0201]
R28439  10K  RESISTOR_0201  [0201]
R28440  10K  RESISTOR_0201  [0201]
R28441  10K  RESISTOR_0201  [0201]
R28442  10K  RESISTOR_0201  [0201]
R28443  10K  RESISTOR_0201  [0201]
R28444  10K  RESISTOR_0201  [0201]
R28445  10K  RESISTOR_0201  [0201]
R28446  10K  RESISTOR_0201  [0201]
R28447  10K  RESISTOR_0201  [0201]
R28448  10K  RESISTOR_0201  [0201]
R28449  10K  RESISTOR_0201  [0201]
R28450  10K  RESISTOR_0201  [0201]
R28451  10K  RESISTOR_0201  [0201]
R28452  10K  RESISTOR_0201  [0201]
R28453  10K  RESISTOR_0201  [0201]
R28454  10K  RESISTOR_0201  [0201]
R28455  10K  RESISTOR_0201  [0201]
R28456  10K  RESISTOR_0201  [0201]
R28457  10K  RESISTOR_0201  [0201]
R28458  10K  RESISTOR_0201  [0201]
R28459  10K  RESISTOR_0201  [0201]
R28460  10K  RESISTOR_0201  [0201]
R28461  10K  RESISTOR_0201  [0201]
R28462  10K  RESISTOR_0201  [0201]
R28463  10K  RESISTOR_0201  [0201]
R28464  10K  RESISTOR_0201  [0201]
R28465  10K  RESISTOR_0201  [0201]
R28466  10K  RESISTOR_0201  [0201]
R28467  10K  RESISTOR_0201  [0201]
R28468  10K  RESISTOR_0201  [0201]
R28469  10K  RESISTOR_0201  [0201]
R28470  10K  RESISTOR_0201  [0201]
R28471  10K  RESISTOR_0201  [0201]
R28472  10K  RESISTOR_0201  [0201]
R28473  10K  RESISTOR_0201  [0201]
R28474  10K  RESISTOR_0201  [0201]
R28475  10K  RESISTOR_0201  [0201]
R28476  10K  RESISTOR_0201  [0201]
R28477  10K  RESISTOR_0201  [0201]
R28478  10K  RESISTOR_0201  [0201]
R28479  10K  RESISTOR_0201  [0201]
R28480  10K  RESISTOR_0201  [0201]
R28481  10K  RESISTOR_0201  [0201]
R28482  10K  RESISTOR_0201  [0201]
R28483  10K  RESISTOR_0201  [0201]
R28484  10K  RESISTOR_0201  [0201]
R28485  10K  RESISTOR_0201  [0201]
R28486  10K  RESISTOR_0201  [0201]
R28487  10K  RESISTOR_0201  [0201]
R28488  10K  RESISTOR_0201  [0201]
R28489  10K  RESISTOR_0201  [0201]
R28490  10K  RESISTOR_0201  [0201]
R28491  10K  RESISTOR_0201  [0201]
R28492  10K  RESISTOR_0201  [0201]
R28493  10K  RESISTOR_0201  [0201]
R28494  10K  RESISTOR_0201  [0201]
R28495  10K  RESISTOR_0201  [0201]
R28496  10K  RESISTOR_0201  [0201]
R28497  10K  RESISTOR_0201  [0201]
R28498  10K  RESISTOR_0201  [0201]
R28499  10K  RESISTOR_0201  [0201]
R28500  10K  RESISTOR_0201  [0201]
R28501  10K  RESISTOR_0201  [0201]
R28502  10K  RESISTOR_0201  [0201]
R28503  10K  RESISTOR_0201  [0201]
R28504  10K  RESISTOR_0201  [0201]
R28505  10K  RESISTOR_0201  [0201]
R28506  10K  RESISTOR_0201  [0201]
R28507  10K  RESISTOR_0201  [0201]
R28508  10K  RESISTOR_0201  [0201]
R28509  10K  RESISTOR_0201  [0201]
R28510  10K  RESISTOR_0201  [0201]
R28511  10K  RESISTOR_0201  [0201]
R28512  10K  RESISTOR_0201  [0201]
R28513  10K  RESISTOR_0201  [0201]
R28514  10K  RESISTOR_0201  [0201]
R28515  10K  RESISTOR_0201  [0201]
R28516  10K  RESISTOR_0201  [0201]
R28517  10K  RESISTOR_0201  [0201]
R28518  10K  RESISTOR_0201  [0201]
R28519  10K  RESISTOR_0201  [0201]
R28520  10K  RESISTOR_0201  [0201]
R28521  10K  RESISTOR_0201  [0201]
R28522  10K  RESISTOR_0201  [0201]
R28523  10K  RESISTOR_0201  [0201]
R28524  10K  RESISTOR_0201  [0201]
R28525  10K  RESISTOR_0201  [0201]
R28526  10K  RESISTOR_0201  [0201]
R28527  10K  RESISTOR_0201  [0201]
R28528  10K  RESISTOR_0201  [0201]
R28529  10K  RESISTOR_0201  [0201]
R28530  10K  RESISTOR_0201  [0201]
R28531  10K  RESISTOR_0201  [0201]
R28532  10K  RESISTOR_0201  [0201]
R28533  10K  RESISTOR_0201  [0201]
R28534  10K  RESISTOR_0201  [0201]
R28535  10K  RESISTOR_0201  [0201]
R28536  10K  RESISTOR_0201  [0201]
R28537  10K  RESISTOR_0201  [0201]
R28538  10K  RESISTOR_0201  [0201]
R28539  10K  RESISTOR_0201  [0201]
R28540  10K  RESISTOR_0201  [0201]
R28541  10K  RESISTOR_0201  [0201]
R28542  10K  RESISTOR_0201  [0201]
R28543  10K  RESISTOR_0201  [0201]
R28544  10K  RESISTOR_0201  [0201]
R28545  10K  RESISTOR_0201  [0201]
R28546  10K  RESISTOR_0201  [0201]
R28547  10K  RESISTOR_0201  [0201]
R28548  10K  RESISTOR_0201  [0201]
R28549  10K  RESISTOR_0201  [0201]
R28550  10K  RESISTOR_0201  [0201]
R28551  10K  RESISTOR_0201  [0201]
R28552  10K  RESISTOR_0201  [0201]
R28553  10K  RESISTOR_0201  [0201]
R28554  10K  RESISTOR_0201  [0201]
R28555  10K  RESISTOR_0201  [0201]
R28556  10K  RESISTOR_0201  [0201]
R28557  10K  RESISTOR_0201  [0201]
R28558  10K  RESISTOR_0201  [0201]
R28559  10K  RESISTOR_0201  [0201]
R28560  10K  RESISTOR_0201  [0201]
R28561  10K  RESISTOR_0201  [0201]
R28562  10K  RESISTOR_0201  [0201]
R28563  10K  RESISTOR_0201  [0201]
R28564  10K  RESISTOR_0201  [0201]
R28565  10K  RESISTOR_0201  [0201]
R28566  10K  RESISTOR_0201  [0201]
R28567  10K  RESISTOR_0201  [0201]
R28568  10K  RESISTOR_0201  [0201]
R28569  10K  RESISTOR_0201  [0201]
R28570  10K  RESISTOR_0201  [0201]
R28571  10K  RESISTOR_0201  [0201]
R28572  10K  RESISTOR_0201  [0201]
R28573  10K  RESISTOR_0201  [0201]
R28574  10K  RESISTOR_0201  [0201]
R28575  10K  RESISTOR_0201  [0201]
R28576  10K  RESISTOR_0201  [0201]
R28577  10K  RESISTOR_0201  [0201]
R28578  10K  RESISTOR_0201  [0201]
R28579  10K  RESISTOR_0201  [0201]
R28580  10K  RESISTOR_0201  [0201]
R28581  10K  RESISTOR_0201  [0201]
R28582  10K  RESISTOR_0201  [0201]
R28583  10K  RESISTOR_0201  [0201]
R28584  10K  RESISTOR_0201  [0201]
R28585  10K  RESISTOR_0201  [0201]
R28586  10K  RESISTOR_0201  [0201]
R28587  10K  RESISTOR_0201  [0201]
R28588  10K  RESISTOR_0201  [0201]
R28589  10K  RESISTOR_0201  [0201]
R28590  10K  RESISTOR_0201  [0201]
R28591  10K  RESISTOR_0201  [0201]
R28592  10K  RESISTOR_0201  [0201]
R28593  10K  RESISTOR_0201  [0201]
R28594  10K  RESISTOR_0201  [0201]
R28595  10K  RESISTOR_0201  [0201]
R28596  10K  RESISTOR_0201  [0201]
R28597  10K  RESISTOR_0201  [0201]
R28598  10K  RESISTOR_0201  [0201]
R28599  10K  RESISTOR_0201  [0201]
R28600  10K  RESISTOR_0201  [0201]
R28601  10K  RESISTOR_0201  [0201]
R28602  10K  RESISTOR_0201  [0201]
R28603  10K  RESISTOR_0201  [0201]
R28604  10K  RESISTOR_0201  [0201]
R28605  10K  RESISTOR_0201  [0201]
R28606  10K  RESISTOR_0201  [0201]
R28607  10K  RESISTOR_0201  [0201]
R28608  10K  RESISTOR_0201  [0201]
R28609  10K  RESISTOR_0201  [0201]
R28610  10K  RESISTOR_0201  [0201]
R28611  10K  RESISTOR_0201  [0201]
R28612  10K  RESISTOR_0201  [0201]
R28613  10K  RESISTOR_0201  [0201]
R28614  10K  RESISTOR_0201  [0201]
R28615  10K  RESISTOR_0201  [0201]
R28616  10K  RESISTOR_0201  [0201]
R28617  10K  RESISTOR_0201  [0201]
R28618  10K  RESISTOR_0201  [0201]
R28619  10K  RESISTOR_0201  [0201]
R28620  10K  RESISTOR_0201  [0201]
R28621  10K  RESISTOR_0201  [0201]
R28622  10K  RESISTOR_0201  [0201]
R28623  10K  RESISTOR_0201  [0201]
R28624  10K  RESISTOR_0201  [0201]
R28625  10K  RESISTOR_0201  [0201]
R28626  10K  RESISTOR_0201  [0201]
R28627  10K  RESISTOR_0201  [0201]
R28628  10K  RESISTOR_0201  [0201]
R28629  10K  RESISTOR_0201  [0201]
R28630  10K  RESISTOR_0201  [0201]
R28631  10K  RESISTOR_0201  [0201]
R28632  10K  RESISTOR_0201  [0201]
R28633  10K  RESISTOR_0201  [0201]
R28634  10K  RESISTOR_0201  [0201]
R28635  10K  RESISTOR_0201  [0201]
R28636  10K  RESISTOR_0201  [0201]
R28637  10K  RESISTOR_0201  [0201]
R28638  10K  RESISTOR_0201  [0201]
R28639  10K  RESISTOR_0201  [0201]
R28640  10K  RESISTOR_0201  [0201]
R28641  10K  RESISTOR_0201  [0201]
R28642  10K  RESISTOR_0201  [0201]
R28643  10K  RESISTOR_0201  [0201]
R28644  10K  RESISTOR_0201  [0201]
R28645  10K  RESISTOR_0201  [0201]
R28646  10K  RESISTOR_0201  [0201]
R28647  10K  RESISTOR_0201  [0201]
R28648  10K  RESISTOR_0201  [0201]
R28649  10K  RESISTOR_0201  [0201]
R28650  10K  RESISTOR_0201  [0201]
R28651  10K  RESISTOR_0201  [0201]
R28652  10K  RESISTOR_0201  [0201]
R28653  10K  RESISTOR_0201  [0201]
R28654  10K  RESISTOR_0201  [0201]
R28655  10K  RESISTOR_0201  [0201]
R28656  10K  RESISTOR_0201  [0201]
R28657  10K  RESISTOR_0201  [0201]
R28658  10K  RESISTOR_0201  [0201]
R28659  10K  RESISTOR_0201  [0201]
R28660  10K  RESISTOR_0201  [0201]
R28661  10K  RESISTOR_0201  [0201]
R28662  10K  RESISTOR_0201  [0201]
R28663  10K  RESISTOR_0201  [0201]
R28664  10K  RESISTOR_0201  [0201]
R28665  10K  RESISTOR_0201  [0201]
R28666  10K  RESISTOR_0201  [0201]
R28667  10K  RESISTOR_0201  [0201]
R28668  10K  RESISTOR_0201  [0201]
R28669  10K  RESISTOR_0201  [0201]
R28670  10K  RESISTOR_0201  [0201]
R28671  10K  RESISTOR_0201  [0201]
R28672  10K  RESISTOR_0201  [0201]
R28673  10K  RESISTOR_0201  [0201]
R28674  10K  RESISTOR_0201  [0201]
R28675  10K  RESISTOR_0201  [0201]
R28676  10K  RESISTOR_0201  [0201]
R28677  10K  RESISTOR_0201  [0201]
R28678  10K  RESISTOR_0201  [0201]
R28679  10K  RESISTOR_0201  [0201]
R28680  10K  RESISTOR_0201  [0201]
R28681  10K  RESISTOR_0201  [0201]
R28682  10K  RESISTOR_0201  [0201]
R28683  10K  RESISTOR_0201  [0201]
R28684  10K  RESISTOR_0201  [0201]
R28685  10K  RESISTOR_0201  [0201]
R28686  10K  RESISTOR_0201  [0201]
R28687  10K  RESISTOR_0201  [0201]
R28688  10K  RESISTOR_0201  [0201]
R28689  10K  RESISTOR_0201  [0201]
R28690  10K  RESISTOR_0201  [0201]
R28691  10K  RESISTOR_0201  [0201]
R28692  10K  RESISTOR_0201  [0201]
R28693  10K  RESISTOR_0201  [0201]
R28694  10K  RESISTOR_0201  [0201]
R28695  10K  RESISTOR_0201  [0201]
R28696  10K  RESISTOR_0201  [0201]
R28697  10K  RESISTOR_0201  [0201]